# EasyEDA Pro project 定时喝水PCB.eprj, schematic 喝水原理图
Create Date: 2024-05-25; Page Name: P1; Project Name: 定时喝水PCB; Schematic Name: 喝水原理图; Update Date: 2024-06-17; Company: 嘉立创EDA; Page Size: A4; Version: V1.0
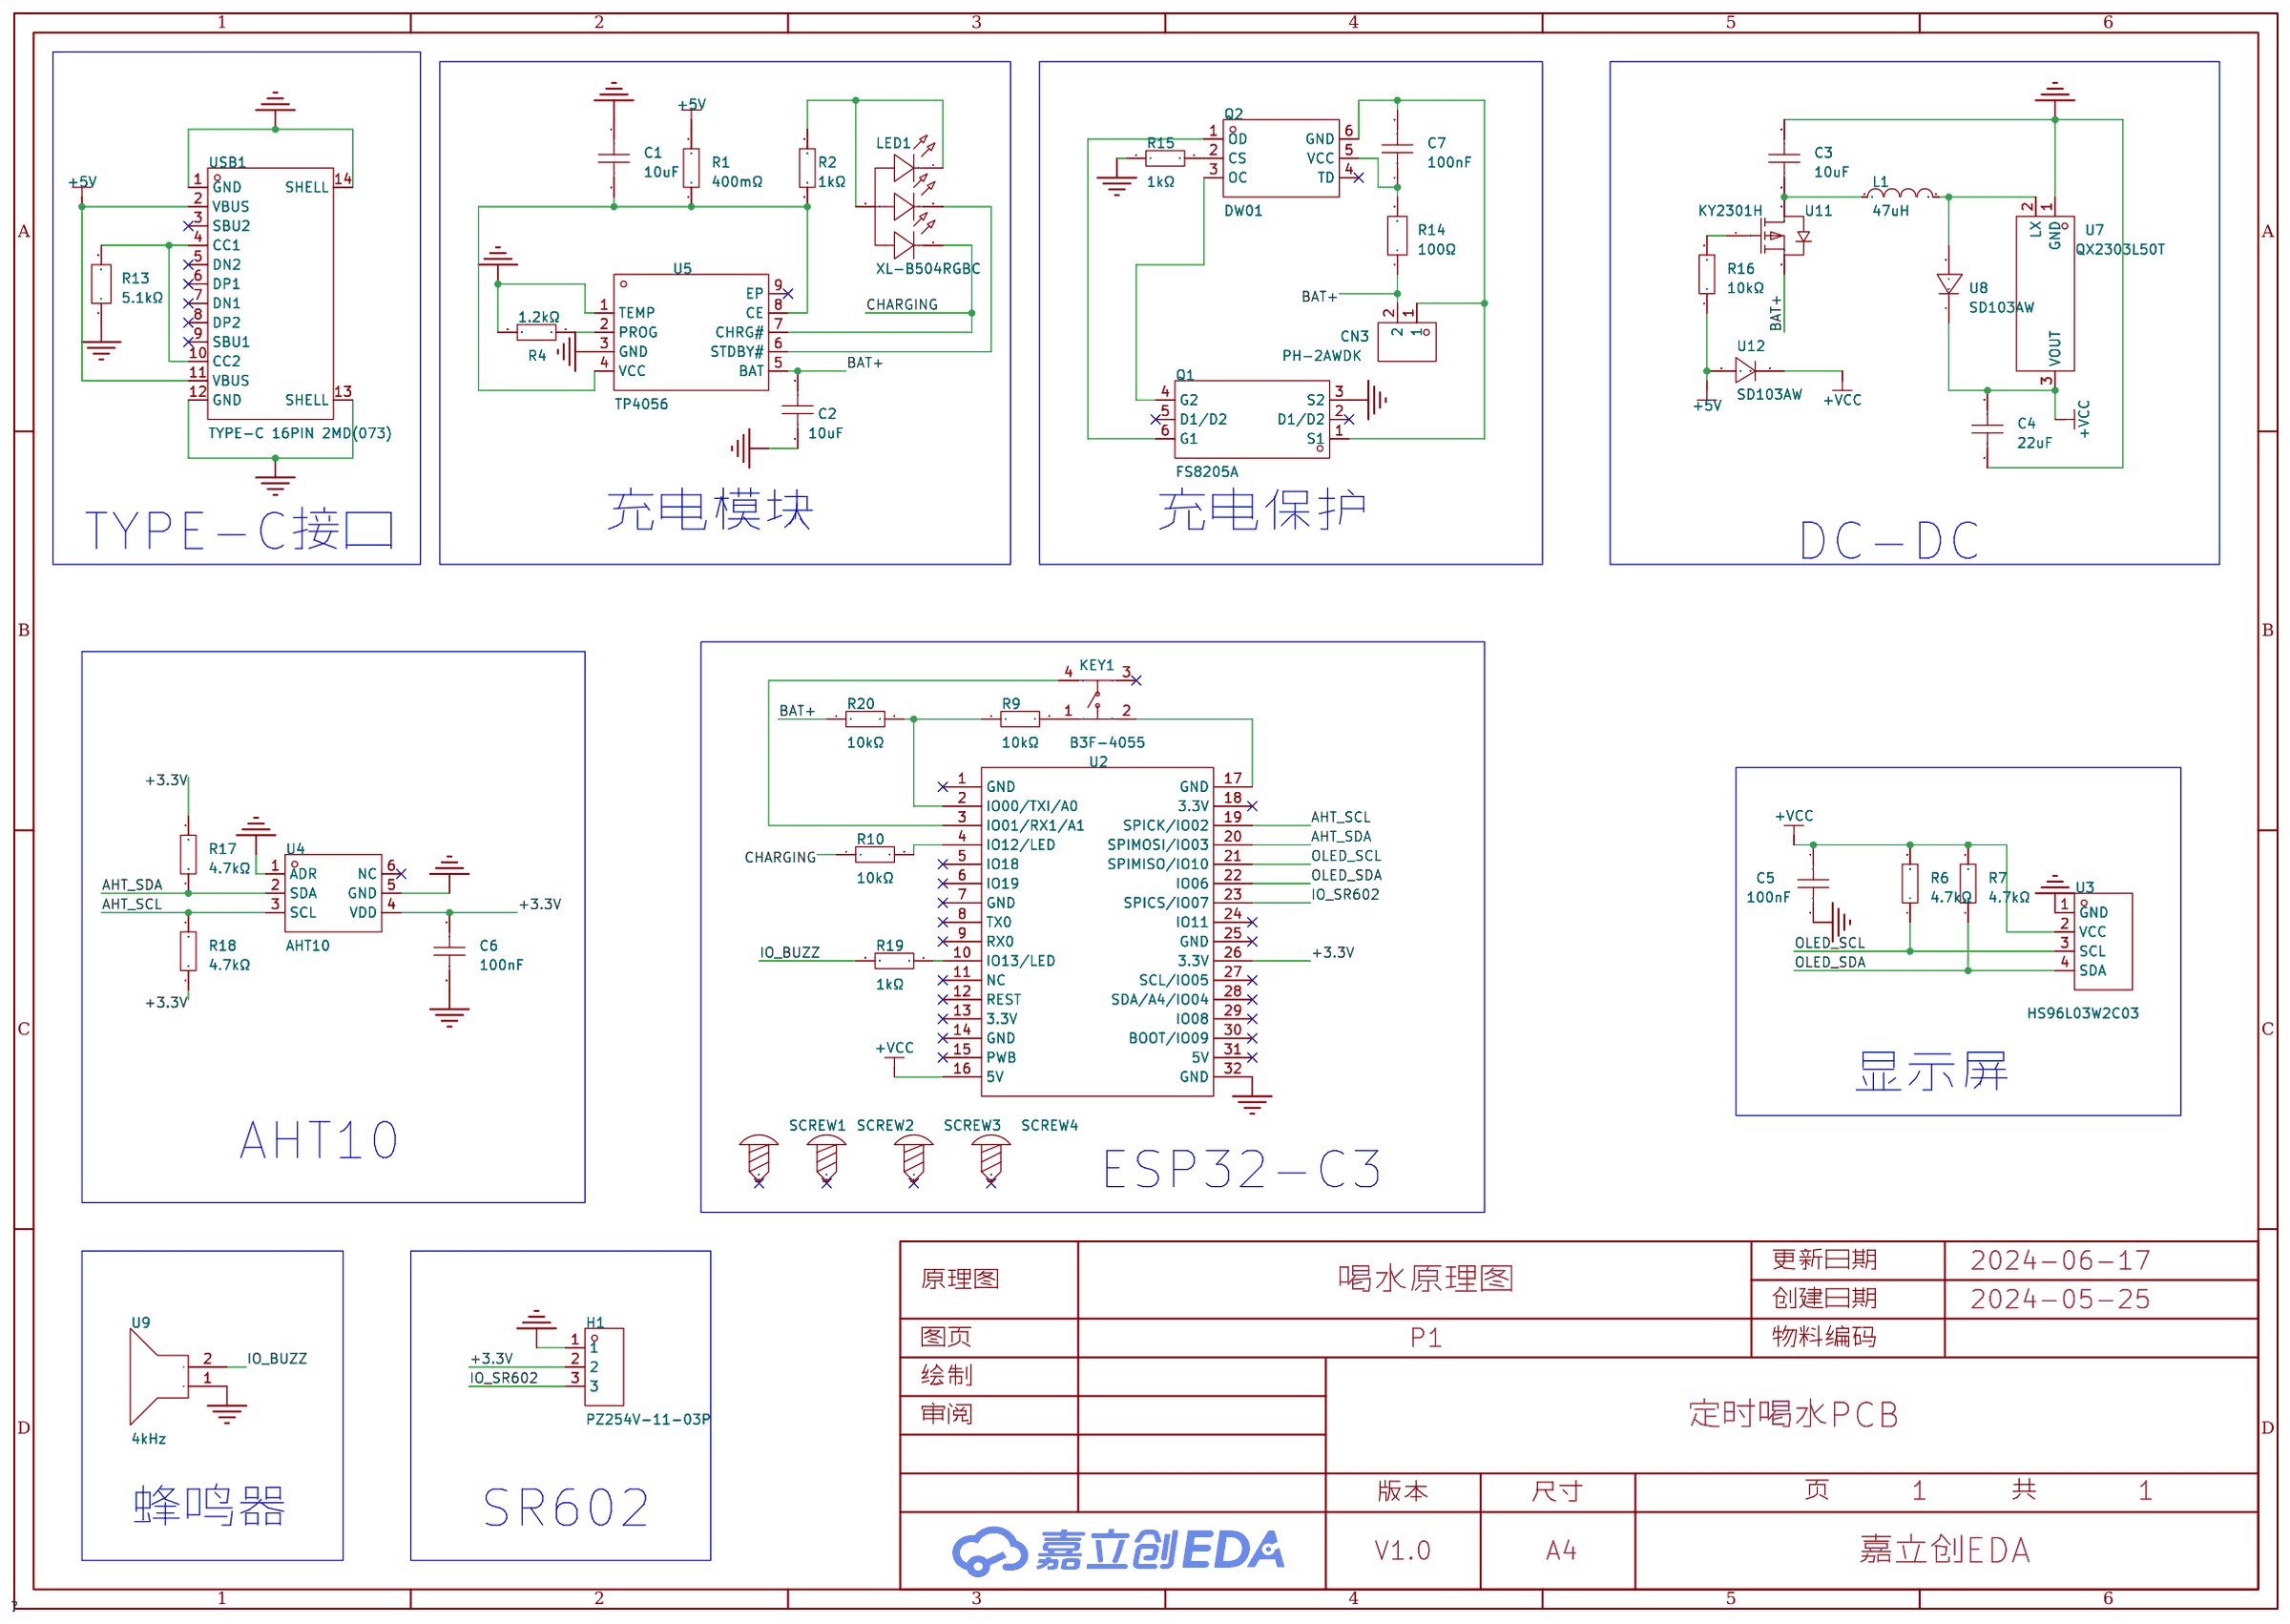
[diagram p0: schematic sheet]

## Parts
C1  10uF  [C0603]
C2  10uF  [C0603]
C3  10uF  [C0603]
C4  22uF  [C0603]
C5  100nF  [C0603]
C6  100nF  [C0603]
C7  100nF  [C0603]
CN3  PH-2AWDK  [CONN-TH_PH-2AWDK]
H1  PZ254V-11-03P  [HDR-TH_3P-P2.54-V-M]
KEY1  B3F-4055  [KEY-TH_4P-L12.0-W12.0-P5.00-LS13.4-EH]
L1  47uH  [IND-SMD_L4.5-W4.0_GCD43-XX]
LED1  XL-B504RGBC  [LED-TH_4P-BD5.8-P1.25]
Q1  FS8205A  [SOT-23-6_L2.9-W1.6-P0.95-LS2.8-BR]
Q2  DW01  [SOT-23-6_L2.9-W1.6-P0.95-LS2.8-BR]
R1  400mΩ  [R0603]
R2  1kΩ  [R0805]
R4  1.2kΩ  [R0603]
R6  4.7kΩ  [R0805]
R7  4.7kΩ  [R0805]
R9  10kΩ  [R0805]
R10  10kΩ  [R0805]
R13  5.1kΩ  [R0603]
R14  100Ω  [R0603]
R15  1kΩ  [R0805]
R16  10kΩ  [R0805]
R17  4.7kΩ  [R0805]
R18  4.7kΩ  [R0805]
R19  1kΩ  [R0805]
R20  10kΩ  [R0805]
SCREW1  -  [M2螺丝]
SCREW2  -  [M2螺丝]
SCREW3  -  [M2螺丝]
SCREW4  -  [M2螺丝]
U2  ESP32C3-合宙  [esp32c3-合宙]
U3  HS96L03W2C03  [OLED-TH_L27.8-W27.2-P2.54_C9900033791]
U4  AHT10  [SENSOR-SMD_AHT10]
U5  TP4056  [ESOP-8_L4.9-W3.9-P1.27-LS6.0-BL-EP]
U7  QX2303L50T  [SOT-23-3_L2.9-W1.6-P1.90-LS2.8-BR]
U8  SD103AW  [SOD-123_L2.8-W1.8-LS3.7-RD]
U9  4kHz  [BUZ-TH_BD12.5-P5.00-D0.9]
U11  KY2301H  [SOT-23-3_L2.9-W1.3-P1.90-LS2.4]
U12  SD103AW  [SOD-123_L2.8-W1.8-LS3.7-RD]
USB1  TYPE-C 16PIN 2MD(073)  [USB-C-SMD_TYPE-C-6PIN-2MD-073]

## Library data of the parts
C1-C3 = CL10A106MQ8NNNC: 容值:10uF;精度:±20%;额定电压:6.3V;材质(温度系数):X5R;; LCSC Part Name: 10uF ±20% 6.3V; Supplier Part: C1691; Manufacturer: SAMSUNG(三星); Supplier Footprint: 0603; JLCPCB Part Class: 扩展库; Datasheet: https://atta.szlcsc.com/upload/public/pdf/source/20160218/1457707763339.pdf; Supplier: LCSC; Tolerance: ±20%; Voltage Rated: 6.3V; Temperature Coefficient: X5R
C4 = CL10A226MQ8NRNC: 容值:22uF;精度:±20%;额定电压:6.3V;材质(温度系数):X5R;; LCSC Part Name: 22uF ±20% 6.3V; Supplier Part: C59461; Manufacturer: SAMSUNG(三星); Supplier Footprint: 0603; JLCPCB Part Class: 基础库; Datasheet: https://atta.szlcsc.com/upload/public/pdf/source/20160218/1457707763339.pdf; Supplier: LCSC; Tolerance: ±20%; Voltage Rated: 6.3V; Temperature Coefficient: X5R
C5-C7 = CL10B104KB8NNNC: 容值:100nF;精度:±10%;额定电压:50V;材质(温度系数):X7R;; LCSC Part Name: 100nF ±10% 50V; Supplier Part: C1591; Manufacturer: SAMSUNG(三星); Supplier Footprint: 0603; JLCPCB Part Class: 扩展库; Datasheet: https://atta.szlcsc.com/upload/public/pdf/source/20160218/1457707763339.pdf; Supplier: LCSC; Tolerance: ±10%; Voltage Rated: 50V; Temperature Coefficient: X7R
CN3 = PH-2AWDK: 插针结构:1x2P;间距:2mm;安装方式:弯插;参考系列:-;总PIN数:2P;排数:1;每排PIN数:2;行距:-;额定电流:2A;工作温度范围:-25℃~+85℃;; LCSC Part Name: 1x2P 间距:2mm 弯插; Supplier Part: C722770; Manufacturer: CAX(创都); Supplier Footprint: 弯插,P=2mm; JLCPCB Part Class: 扩展库; Datasheet: https://atta.szlcsc.com/upload/public/pdf/source/20200902/C722770_2126FD87B413D40D3BC974724BF851A4.pdf; Supplier: LCSC; Pins Structure: 1x2P; Pitch: 2mm; Mounting Style: 弯插; Number of Pins: 2P; Number of Rows: 1; Number of PINs Per Row: 2; Current Rating (Max): 2A; Operating Temperature Range: -25℃~+85℃
H1 = PZ254V-11-03P: 插针结构:1x3P;间距:2.54mm;行距:-;圆针/方针:方针;安装类型:直插;排数:单排;总PIN位数:3P;额定电流:3A;额定电压:250V;配合针长度:6mm;塑高:2.5mm;端接针长度:3mm;工作温度范围:-40℃~+105℃;颜色:黑色;; LCSC Part Name: 间距:2.54mm 1x3P 直插 方针; Supplier Part: C2937625; Manufacturer: XFCN(兴飞); Supplier Footprint: 插件,P=2.54mm; JLCPCB Part Class: 扩展库; Datasheet: https://atta.szlcsc.com/upload/public/pdf/source/20200309/C492402_8335C3D49C4E4C618838D59BB1D024C1.pdf; Supplier: LCSC; Pin Structure: 1x3P; Pitch: 2.54mm; Circluar Pins/Square Pins: 方针; Mounting Type: 直插; Number of Rows: 单排; Number of Pins: 3P; Current Rating (Max): 3A; Voltage Rating (Max): 250V; Length of Mating Pin: 6mm; Insulation Height: 2.5mm; Length of End Connection Pin: 3mm; Operating Temperature Range: -40℃~+105℃; Color: 黑色
KEY1 = B3F-4055_C84931: 电路结构:单刀单掷;按钮形状:矩形按钮;安装方式:直插;开关长度:12mm;开关宽度:12mm;开关高度:7.3mm;触点电流:50mA;额定电压(DC):24V;带灯:-;机械寿命:-;; LCSC Part Name: 12*12*7.3mm 直插 轻触开关; Supplier Part: C84931; Manufacturer: OMRON(欧姆龙); Supplier Footprint: 插件; JLCPCB Part Class: 扩展库; Datasheet: https://atta.szlcsc.com/upload/public/pdf/source/20170810/C93157_1502335414592880008.pdf; Supplier: LCSC; Circuit: 单刀单掷; Actuator Style: 矩形按钮; Mounting Style: 直插; Switch Length: 12mm; Switch Width: 12mm; Switch Height: 7.3mm; Contact Current: 50mA; Voltage Rating (DC): 24V
L1 = CD42YP0402-470M: 电感值:47uH;精度:±20%;额定电流:400mA;; LCSC Part Name: 47uH ±20%; Supplier Part: C492272; Manufacturer: YJYCOIN(益嘉源); Supplier Footprint: SMD,4.5x4x2mm; JLCPCB Part Class: 扩展库; Datasheet: https://atta.szlcsc.com/upload/public/pdf/source/20200311/C492271_1AD102F2D00E7755211BAB8FE66CC08D.pdf; Supplier: LCSC; Tolerance: ±20%; Rated Current: 400mA; DC Resistance (DCR): 950mΩ
LED1 = XL-B504RGBC: F5七彩长脚透明共阳; Supplier Part: C7371895; Manufacturer: XINGLIGHT(成兴光); Supplier Footprint: 插件,D=5mm; JLCPCB Part Class: 扩展库; Datasheet: https://atta.szlcsc.com/upload/public/pdf/source/20240218/FDD5DF05EF14104572D4BED678224B3A.pdf; Supplier: LCSC
Q1 = FS8205A: 类型:2个N沟道;漏源电压(Vdss):20V;连续漏极电流(Id):6A;功率(Pd):1.5W;导通电阻(RDS(on)@Vgs,Id):19.5mΩ@4.5V,3A;阈值电压(Vgs(th)@Id):700mV@250uA;; LCSC Part Name: 2个N沟道 耐压:20V 电流:6A; Supplier Part: C2830320; Manufacturer: TECH PUBLIC(台舟); Supplier Footprint: SOT-23-6; JLCPCB Part Class: 扩展库; Datasheet: https://atta.szlcsc.com/upload/public/pdf/source/20210810/F53B6D4E8755A1F8E11BAF814CE98E6A.pdf; Supplier: LCSC; Type: 2个N沟道; Drain Source Voltage (Vdss): 20V; Continuous Drain Current (Id): 6A; Power Dissipation (Pd): 1.5W; Drain Source On Resistance (RDS(on)@Vgs,Id): 19.5mΩ@4.5V,3A; Gate Threshold Voltage (Vgs(th)@Id): 700mV@250uA; Total Gate Charge (Qg@Vgs): 5.7nC@10V; Input Capacitance (Ciss@Vds): 466pF@10V; Reverse Transfer Capacitance (Crss@Vds): 58pF@10V; Operating Temperature: -55℃~+150℃@(Tj)
Q2 = DW01_C181096: Supplier Part: C181096; Manufacturer: Hottech(合科泰); Supplier Footprint: SOT-23-6; JLCPCB Part Class: 扩展库; Datasheet: https://atta.szlcsc.com/upload/public/pdf/source/20231007/94AC323C2B651AEA18C7FC8F0156E5A9.pdf; Supplier: LCSC
R1 = 0603WAJ040KT5E: 电阻类型:厚膜电阻;阻值:400mΩ;精度:±5%;功率:100mW;最大工作电压:75V;; LCSC Part Name: 400mΩ ±5% 100mW 厚膜电阻; Supplier Part: C247571; Manufacturer: UNI-ROYAL(厚声); Supplier Footprint: 0603; JLCPCB Part Class: 扩展库; Supplier: LCSC; Type: 厚膜电阻; Tolerance: ±5%; Power(Watts): 100mW; Overload Voltage (Max): 75V; Operating Temperature Range: -55℃~+155℃
R2 R15 R19 = RC0805FR-071KL: 电阻类型:厚膜电阻;阻值:1kΩ;精度:±1%;功率:125mW;最大工作电压:150V;温度系数:±100ppm/℃;; LCSC Part Name: 厚膜电阻 1kΩ ±1% 125mW; Supplier Part: C95781; Manufacturer: YAGEO(国巨); Supplier Footprint: 0805; JLCPCB Part Class: 扩展库; Datasheet: https://atta.szlcsc.com/upload/public/pdf/source/20170708/1499509500945.pdf; Supplier: LCSC; Type: 厚膜电阻; Tolerance: ±1%; Power(Watts): 125mW; Overload Voltage (Max): 150V; Temperature Coefficient: ±100ppm/℃; Operating Temperature Range: -55℃~+155℃
R4 = WR06X122JTL: 电阻类型:厚膜电阻;阻值:1.2kΩ;精度:±5%;功率:100mW;最大工作电压:75V;温度系数:±100ppm/℃;; LCSC Part Name: 厚膜电阻 1.2kΩ ±5% 100mW; Supplier Part: C168366; Manufacturer: Walsin(华新科); Supplier Footprint: 0603; JLCPCB Part Class: 扩展库; Datasheet: https://atta.szlcsc.com/upload/public/pdf/source/20191217/C470037_D99261402F77DA8B1D609223749D445A.pdf; Supplier: LCSC; Type: 厚膜电阻; Tolerance: ±5%; Power(Watts): 100mW; Overload Voltage (Max): 75V; Temperature Coefficient: ±100ppm/℃; Operating Temperature Range: -55℃~+155℃
R6 R7 R17 R18 = 0805W8F4701T5E: 电阻类型:厚膜电阻;阻值:4.7kΩ;精度:±1%;功率:125mW;最大工作电压:150V;温度系数:±100ppm/℃;; LCSC Part Name: 4.7kΩ ±1% 125mW 厚膜电阻; Supplier Part: C17673; Manufacturer: UNI-ROYAL(厚声); Supplier Footprint: 0805; JLCPCB Part Class: 基础库; Datasheet: https://atta.szlcsc.com/upload/public/pdf/source/20200306/C422600_1E6D84923E4A46A82E41ADD87F860B5C.pdf; Supplier: LCSC; Type: 厚膜电阻; Tolerance: ±1%; Power(Watts): 125mW; Overload Voltage (Max): 150V; Temperature Coefficient: ±100ppm/℃; Operating Temperature Range: -55℃~+155℃
R9 R10 R16 R20 = AC0805FR-0710KL: 电阻类型:厚膜电阻;阻值:10kΩ;精度:±1%;功率:125mW;最大工作电压:150V;温度系数:±100ppm/℃;; LCSC Part Name: 厚膜电阻 10kΩ ±1% 125mW; Supplier Part: C140868; Manufacturer: YAGEO(国巨); Supplier Footprint: 0805; JLCPCB Part Class: 扩展库; Datasheet: https://atta.szlcsc.com/upload/public/pdf/source/20180927/C229861_4ABDC471507C1ED6AFB4BA66AFC8620A.pdf; Supplier: LCSC; Type: 厚膜电阻; Tolerance: ±1%; Power(Watts): 125mW; Overload Voltage (Max): 150V; Temperature Coefficient: ±100ppm/℃; Operating Temperature Range: -55℃~+155℃
R13 = SCR0603J5K1: 电阻类型:厚膜电阻;阻值:5.1kΩ;精度:±5%;功率:100mW;最大工作电压:75V;; LCSC Part Name: 厚膜电阻 5.1kΩ ±5% 100mW; Supplier Part: C3017721; Manufacturer: VO(翔胜); Supplier Footprint: 0603; JLCPCB Part Class: 扩展库; Datasheet: https://atta.szlcsc.com/upload/public/pdf/source/20220513/247AF9639BA21CF93567DC289CCC6A22.pdf; Supplier: LCSC; Type: 厚膜电阻; Tolerance: ±5%; Power(Watts): 100mW; Overload Voltage (Max): 75V; Operating Temperature Range: -55℃~+155℃
R14 = SCR0603J100R: 电阻类型:厚膜电阻;阻值:100Ω;精度:±5%;功率:100mW;最大工作电压:75V;; LCSC Part Name: 厚膜电阻 100Ω ±5% 100mW; Supplier Part: C3017758; Manufacturer: VO(翔胜); Supplier Footprint: 0603; JLCPCB Part Class: 扩展库; Datasheet: https://atta.szlcsc.com/upload/public/pdf/source/20220513/247AF9639BA21CF93567DC289CCC6A22.pdf; Supplier: LCSC; Type: 厚膜电阻; Tolerance: ±5%; Power(Watts): 100mW; Overload Voltage (Max): 75V; Operating Temperature Range: -55℃~+155℃
SCREW1-SCREW4 = M2螺丝: Supplier Footprint: 插件
U2 = ESP32C3-合宙: ESP32C3-核心板-经典
U3 = HS96L03W2C03: 主控芯片:SSD1315;接口类型:I2C;尺寸(inch):0.96;像素分辨率:128x64;; LCSC Part Name: 0.96寸OLED显示屏窄白光IIC; Supplier Part: C5248080; Manufacturer: HS(汉昇); JLCPCB Part Class: 扩展库; Datasheet: https://atta.szlcsc.com/upload/public/pdf/source/20230627/763D01F79A90007632F098068C7C8AD9.pdf; Supplier: LCSC; Main Control Chip: SSD1315; Interface Type: I2C; Size: 0.96; Pixel Resolution: 128x64; Operating Temperature: -40℃~+70℃
U4 = AHT10: Supplier Part: C368909; Manufacturer: 广州奥松; Supplier Footprint: SMD; JLCPCB Part Class: 扩展库; Datasheet: https://atta.szlcsc.com/upload/public/pdf/source/20190129/C368909_B294364A5189322D50DF5028F78C32FD.pdf; Supplier: LCSC
U5 = TP4056_C725790: Supplier Part: C725790; Manufacturer: UMW(友台半导体); Supplier Footprint: ESOP-8; JLCPCB Part Class: 扩展库; Datasheet: https://atta.szlcsc.com/upload/public/pdf/source/20231109/CF74897CE79A500F7FE27A45ADCCC631.pdf; Supplier: LCSC
U7 = QX2303L50T: 功能类型:升压型;输入电压:700mV~5V;输出电压:5V;输出电流(最大值):800mA;; Supplier Part: C219027; Manufacturer: 泉芯; Supplier Footprint: SOT-23; JLCPCB Part Class: 扩展库; Datasheet: https://atta.szlcsc.com/upload/public/pdf/source/20180504/C219029_F6F454D8D716C83066415AA2EC25C4AD.pdf; Supplier: LCSC; Function: 升压型; Input Voltage: 700mV~5V; Output Voltage: 5V; Output Current (Max): 800mA; Switching Frequency: 300kHz; Synchronous Rectification: 否; Number of Outputs: 1; Topology: 升压式; Switch tube (built-in/external): 内置
U8 U12 = SD103AW_C5345965: 二极管配置:独立式;正向压降(Vf):600mV@200mA;直流反向耐压(Vr):40V;平均整流电流(Io):350mA;; LCSC Part Name: 电压:40V 电流:350mA S4; Supplier Part: C5345965; Manufacturer: HXY MOSFET(华轩阳电子); Supplier Footprint: SOD-123; JLCPCB Part Class: 扩展库; Datasheet: https://atta.szlcsc.com/upload/public/pdf/source/20230718/C15AB3BEAEB1A66CBDFF5A426E492919.pdf; Supplier: LCSC; Diode Configuration: 独立式; Forward Voltage (Vf@If): 600mV@200mA; Reverse Voltage (Vr): 40V; Average Rectified Current (Io): 350mA; Reverse Leakage Current (Ir): 5uA@30V; Peak forward surge current: 2A
U9 = SFN-1270-0540-35P5.0: 驱动方式:无源(外部驱动);构造类型:压电式;频率:4kHz;声压(SPL):80dB;; Supplier Part: C3015481; Manufacturer: S&S(海旭); Supplier Footprint: 插件,D=12.5mm; JLCPCB Part Class: 扩展库; Datasheet: https://atta.szlcsc.com/upload/public/pdf/source/20220517/E2F404692071743447D3DA4216E14D26.pdf; Supplier: LCSC; Oscillator Circuit: 无源(外部驱动); Technology Type: 压电式; Operating Voltage: 30V; Sound Pressure Level (SPL): 80dB; Diameter (φD): 12.5mm; Height: 7mm
U11 = KY2301H: 类型:1个P沟道;漏源电压(Vdss):20V;连续漏极电流(Id):3A;功率(Pd):400mW;导通电阻(RDS(on)@Vgs,Id):76mΩ@4.5V,1A;阈值电压(Vgs(th)@Id):600mV@250uA;; LCSC Part Name: 1个P沟道 耐压:20V 电流:3A; Supplier Part: C3029274; Manufacturer: KY(韩景元); Supplier Footprint: SOT-23; JLCPCB Part Class: 扩展库; Datasheet: https://atta.szlcsc.com/upload/public/pdf/source/20220602/7F2945A9F5D68E0B5E25374511417CB5.pdf; Supplier: LCSC; Type: 1个P沟道; Drain Source Voltage (Vdss): 20V; Continuous Drain Current (Id): 3A; Power Dissipation (Pd): 400mW; Drain Source On Resistance (RDS(on)@Vgs,Id): 76mΩ@4.5V,1A; Gate Threshold Voltage (Vgs(th)@Id): 600mV@250uA; Total Gate Charge (Qg@Vgs): 6nC@2.5V; Input Capacitance (Ciss@Vds): 450pF@10V; Reverse Transfer Capacitance (Crss@Vds): 55pF@10V; Operating Temperature: -55℃~+150℃@(Tj)
USB1 = TYPE-C 16PIN 2MD(073): 连接器类型:Type-C;标准:-;公母:母;端口数量:1;触点数量:16P;安装方式:卧贴;额定电流 - 电源:5A;工作温度范围:-25℃~+85℃;; LCSC Part Name: Type-C 母 卧贴; Supplier Part: C2765186; Manufacturer: SHOU HAN(首韩); Supplier Footprint: SMD; JLCPCB Part Class: 扩展库; Datasheet: https://atta.szlcsc.com/upload/public/pdf/source/20211123/39B17C16241EAC15C5E277BDA434118E.pdf; Supplier: LCSC; Connector Type: Type-C; Gender: 母; Number of Ports: 1; Number of Contacts: 16P; Mounting Style: 卧贴; Current Rating - Power (Max): 5A; Operating Temperature Range: -25℃~+85℃

## Nets
+3.3V: C6.1 H1.2 R17.2 R18.1 U2.26(3.3V) U4.4(VDD)
+5V: R1.1 R16.1 U12.2(A) USB1.2(VBUS) USB1.11(VBUS)
+VCC: C4.2 C5.1 R6.2 R7.2 U2.16(5V) U3.2(VCC) U7.3(VOUT) U8.1(C) U12.1(C)
GND: C1.1 C2.1 C3.2 C4.1 C5.2 C6.2 H1.1 Q1.3(S2) R4.2 R13.1 R15.1 U2.32(GND) U3.1(GND) U4.1(ADR) U4.5(GND) U5.1(TEMP) U5.3(GND) U7.1(GND) U9.1(+) USB1.1(GND) USB1.12(GND) USB1.13(SHELL) USB1.14(SHELL)
AHT_SCL: R18.2 U2.19(SPICK/IO02) U4.3(SCL)
AHT_SDA: R17.1 U2.20(SPIMOSI/IO03) U4.2(SDA)
BAT+: C2.2 CN3.2 R14.1 R20.1 U5.5(BAT) U11.2(S)
CHARGING: LED1.2(R-) R10.1 U5.7(CHRG#)
IO_BUZZ: R19.2 U9.2(-)
IO_SR602: H1.3 U2.23(SPICS/IO07)
OLED_SCL: R6.1 U2.21(SPIMISO/IO10) U3.3(SCL)
OLED_SDA: R7.1 U2.22(IO06) U3.4(SDA)
$1N2086: LED1.3(G-) U5.6(STDBY#)
$1N2169: R4.1 U5.2(PROG)
$1N2994: LED1.1(A) LED1.4(B-) R2.2
$1N2995: C1.2 R1.2 R2.1 U5.4(VCC) U5.8(CE)
$1N3520: L1.2 U7.2(LX) U8.2(A)
$1N9123: R13.2 USB1.4(CC1) USB1.10(CC2)
$1N9611: Q1.4(G2) Q2.3(OC)
$1N9631: Q1.6(G1) Q2.1(OD)
$1N9833: Q2.2(CS) R15.2
$1N10240: R16.2 U11.1(G)
$1N10297: C3.1 L1.1 U11.3(D)
$1N10551: KEY1.2 U2.17(GND)
$1N10631: R9.1 R20.2 U2.2(IO00/TXI/A0)
$1N10634: KEY1.1 R9.2
$1N10700: KEY1.4 U2.3(IO01/RX1/A1)
$1N12015: R10.2 U2.4(IO12/LED)
$1N12092: R19.1 U2.10(IO13/LED)
$1N12145: C7.2 CN3.1 Q1.1(S1) Q2.6(GND)
$1N12201: C7.1 Q2.5(VCC) R14.2

Not connected (* = marked no-connect by the designer): KEY1 3*; Q1 2(D1/D2)* 5(D1/D2)*; Q2 4(TD)*; SCREW1 1*; SCREW2 1*; SCREW3 1*; SCREW4 1*; U2 1(GND)* 5(IO18)* 6(IO19)* 7(GND)* 8(TX0)* 9(RX0)* 11(NC)* 12(REST)* 13(3.3V)* 14(GND)* 15(PWB)* 18(3.3V)* 24(IO11)* 25(GND)* 27(SCL/IO05)* 28(SDA/A4/IO04)* 29(IO08)* 30(BOOT/IO09)* 31(5V)*; U4 6(NC)*; U5 9(EP)*; USB1 3(SBU2)* 5(DN2)* 6(DP1)* 7(DN1)* 8(DP2)* 9(SBU1)*

## Notes on the sheet
- 充电模块
- 充电保护
- TYPE-C接口
- DC-DC
- 显示屏
- AHT10
- ESP32-C3
- 蜂鸣器
- SR602
